# EasyEDA Pro project STM32F407VET6最小系统板.eprj, board STM32F407最小系统板_V01
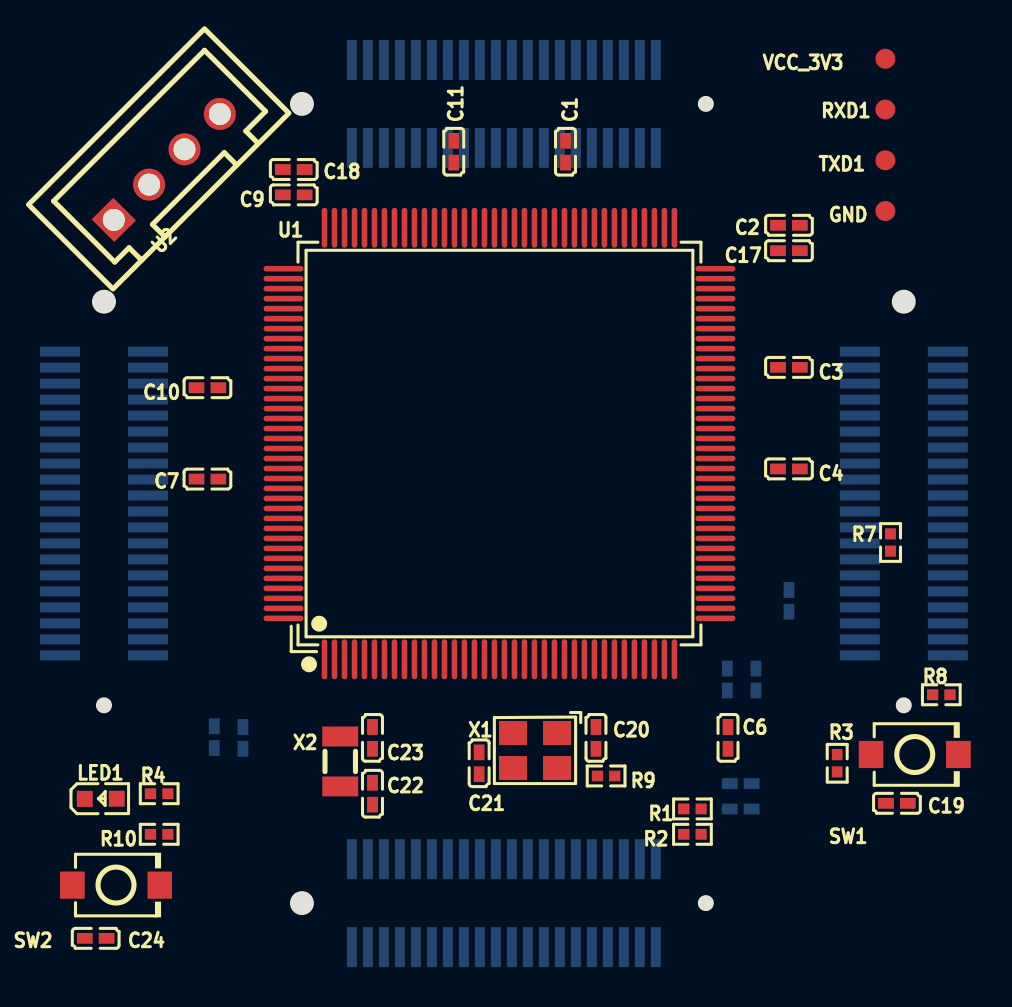
[diagram p4: board, top side]
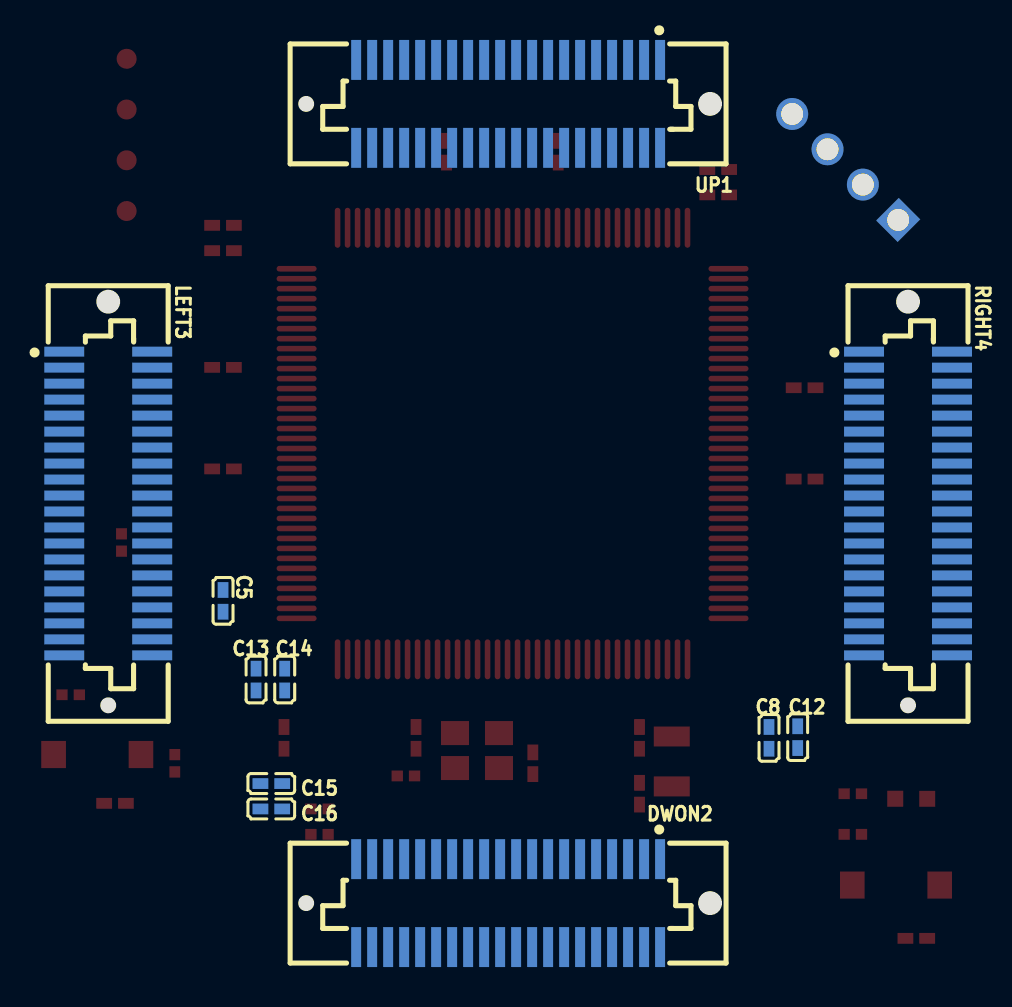
[diagram p5: board, bottom side, seen from below]

Outline 41.19 x 41.19 mm; copper layers: Top Layer, Bottom Layer. Coordinates in mm from the lower left corner of the outline.
Stack: Top Layer 0.035mm / Dielectric1 1.51mm FR4 er 4.5 / Bottom Layer 0.035mm

## Design rules (mm)
template: JLCPCB Capability(Two Layers Board)
spacing copperThickness1oz (default): track to track 0.102, other pairs 0.152 to 0.3
spacing copperThickness2oz: track to track 0.203, other pairs 0.152 to 0.3
track width copperThickness1oz (default): min 0.127, default 0.254, max 2.54
track width copperThickness2oz: min 0.203, default 0.254, max 2.54
differential pair differentialPair (default): width min 0.127, default 0.254, max 2.54; gap min 0.152, default 0.152
via viaSize (default): diameter min 0.5, default 0.61, max 10; hole min 0.3, default 0.305, max 6.3

## Placement (name value [footprint] x y rotation side)
C1  100nF  [C0402]  23.68 38.2 270 top
C2  100nF  [C0402]  34.85 34.52 180 top
C3  100nF  [C0402]  34.85 27.41 180 top
C4  100nF  [C0402]  34.85 22.33 180 top
C5  100nF  [C0402]  34.85 15.72 90 bottom
C6  100nF  [C0402]  31.8 8.86 90 top
C7  100nF  [C0402]  5.77 21.82 0 top
C8  100nF  [C0402]  7.55 8.86 90 bottom
C9  100nF  [C0402]  10.09 36.04 0 top
C10  100nF  [C0402]  5.77 26.39 0 top
C11  100nF  [C0402]  18.09 38.2 270 top
C12  4.7uF  [C0402]  6.11 8.9 90 bottom
C13  1uF  [C0402]  33.2 11.78 270 bottom
C14  100nF  [C0402]  31.77 11.78 270 bottom
C15  1uF  [C0402]  32.44 6.58 0 bottom
C16  100nF  [C0402]  32.44 5.31 0 bottom
C17  2.2uF  [C0402]  34.85 33.25 180 top
C18  2.2uF  [C0402]  10.09 37.31 0 top
C19  100nF  [C0402]  40.25 5.59 0 top
C20  12pF  [C0402]  25.2 8.86 90 top
C21  12pF  [C0402]  19.36 7.59 90 top
C22  12pF  [C0402]  14.02 6.07 90 top
C23  12pF  [C0402]  14.02 8.86 270 top
C24  100nF  [C0402]  0.18 -1.17 0 top
DWON2  X0802FVS-40AS-LPV01  [CONN-SMD_40P-P0.80_XKB_X0802FVS-40ADS-LPV01]  20.59 0.59 0 bottom
GND  -  [test-point-0.5mm]  39.67 35.23 0 top
LED1  XL-1608SURC-06  [LED0603-RD_RED]  0.43 5.82 0 top
LEFT3  X0802FVS-40AS-LPV01  [CONN-SMD_40P-P0.80_XKB_X0802FVS-40ADS-LPV01]  40.59 20.59 270 bottom
R1  0Ω  [R0402]  30.03 5.31 0 top
R2  0Ω  [R0402]  30.03 4.04 0 top
R3  10kΩ  [R0402]  37.26 7.59 90 top
R4  10kΩ  [R0402]  3.36 6.07 180 top
R7  10kΩ  [R0402]  39.93 18.64 270 top
R8  10kΩ  [R0402]  42.47 11.02 180 top
R9  1MΩ  [R0402]  25.71 6.96 0 top
R10  10kΩ  [R0402]  3.36 4.04 0 top
RIGHT4  X0802FVS-40AS-LPV01  [CONN-SMD_40P-P0.80_XKB_X0802FVS-40ADS-LPV01]  0.59 20.59 270 bottom
RXD1  -  [test-point-0.5mm]  39.67 40.31 0 top
SW1  TS-1088R-02026  [SW-SMD_L3.9-W3.0-P4.45]  41.14 8.03 0 top
SW2  TS-1088R-02026  [SW-SMD_L3.9-W3.0-P4.45]  1.2 1.5 0 top
TXD1  -  [test-point-0.5mm]  39.67 37.77 0 top
U1  STM32F407ZET6  [LQFP-144_L20.0-W20.0-P0.50-LS22.0-BL]  20.37 23.6 0 top
U2  ZX-XH2.54-4PZZ  [CONN-TH_4P-P2.50_4PIN]  3.74 37.44 45 top
UP1  X0802FVS-40AS-LPV01  [CONN-SMD_40P-P0.80_XKB_X0802FVS-40ADS-LPV01]  20.59 40.59 0 bottom
VCC_3V3  -  [test-point-0.5mm]  39.67 42.85 0 top
X1  8MHz  [OSC-SMD_4P-L3.2-W2.5-BL]  22.15 8.23 180 top
X2  32.768kHz  [FC-135R_L3.2-W1.5]  12.41 7.68 270 top

## Footprints (pads in the part's own frame, mm; a bottom-side part is the same pattern mirrored in y, then rotated)
C0402
  rect 0.79x0.54 smd: 1(-0.545,0) 2(0.545,0)
CONN-SMD_40P-P0.80_XKB_X0802FVS-40ADS-LPV01
  rect 0.5x2 smd: 1(-7.6,-2.2) 2(-7.6,2.2) 3(-6.8,-2.2) 4(-6.8,2.2) 5(-6,-2.2) 6(-6,2.2) 7(-5.2,-2.2) 8(-5.2,2.2) 9(-4.4,-2.2) 10(-4.4,2.2) 11(-3.6,-2.2) 12(-3.6,2.2) 13(-2.8,-2.2) 14(-2.8,2.2) 15(-2,-2.2) 16(-2,2.2) 17(-1.2,-2.2) 18(-1.2,2.2) 19(-0.4,-2.2) 20(-0.4,2.2) 21(0.4,-2.2) 22(0.4,2.2) 23(1.2,-2.2) 24(1.2,2.2) 25(2,-2.2) 26(2,2.2) 27(2.8,-2.2) 28(2.8,2.2) 29(3.6,-2.2) 30(3.6,2.2) 31(4.4,-2.2) 32(4.4,2.2) 33(5.2,-2.2) 34(5.2,2.2) 35(6,-2.2) 36(6,2.2) 37(6.8,-2.2) 38(6.8,2.2) 39(7.6,-2.2) 40(7.6,2.2)
CONN-TH_4P-P2.50_4PIN
  rect 1.524x1.6 hole 1.1: 1(-3.75,0)
  round 1.6 hole 1.1: 2(-1.25,0) 3(1.25,0) 4(3.75,0)
FC-135R_L3.2-W1.5
  rect 1x1.8 smd: 1(-1.25,0) 2(1.25,0)
LED0603-RD_RED
  rect 0.8x0.8 smd: 1(-0.799,-0.004) 2(0.799,0.004)
LQFP-144_L20.0-W20.0-P0.50-LS22.0-BL
  oval 0.28x2 smd: 1(-8.75,-10.8) 2(-8.25,-10.8) 3(-7.75,-10.8) 4(-7.25,-10.8) 5(-6.75,-10.8) 6(-6.25,-10.8) 7(-5.75,-10.8) 8(-5.25,-10.8) 9(-4.75,-10.8) 10(-4.25,-10.8) 11(-3.75,-10.8) 12(-3.25,-10.8) 13(-2.75,-10.8) 14(-2.25,-10.8) 15(-1.75,-10.8) 16(-1.25,-10.8) 17(-0.75,-10.8) 18(-0.25,-10.8) 19(0.25,-10.8) 20(0.75,-10.8) 21(1.25,-10.8) 22(1.75,-10.8) 23(2.25,-10.8) 24(2.75,-10.8) 25(3.25,-10.8) 26(3.75,-10.8) 27(4.25,-10.8) 28(4.75,-10.8) 29(5.25,-10.8) 30(5.75,-10.8) 31(6.25,-10.8) 32(6.75,-10.8) 33(7.25,-10.8) 34(7.75,-10.8) 35(8.25,-10.8) 36(8.75,-10.8) 73(8.75,10.8) 74(8.25,10.8) 75(7.75,10.8) 76(7.25,10.8) 77(6.75,10.8) 78(6.25,10.8) 79(5.75,10.8) 80(5.25,10.8) 81(4.75,10.8) 82(4.25,10.8) 83(3.75,10.8) 84(3.25,10.8) 85(2.75,10.8) 86(2.25,10.8) 87(1.75,10.8) 88(1.25,10.8) 89(0.75,10.8) 90(0.25,10.8) 91(-0.25,10.8) 92(-0.75,10.8) 93(-1.25,10.8) 94(-1.75,10.8) 95(-2.25,10.8) 96(-2.75,10.8) 97(-3.25,10.8) 98(-3.75,10.8) 99(-4.25,10.8) 100(-4.75,10.8) 101(-5.25,10.8) 102(-5.75,10.8) 103(-6.25,10.8) 104(-6.75,10.8) 105(-7.25,10.8) 106(-7.75,10.8) 107(-8.25,10.8) 108(-8.75,10.8)
  oval 2x0.28 smd: 37(10.8,-8.75) 38(10.8,-8.25) 39(10.8,-7.75) 40(10.8,-7.25) 41(10.8,-6.75) 42(10.8,-6.25) 43(10.8,-5.75) 44(10.8,-5.25) 45(10.8,-4.75) 46(10.8,-4.25) 47(10.8,-3.75) 48(10.8,-3.25) 49(10.8,-2.75) 50(10.8,-2.25) 51(10.8,-1.75) 52(10.8,-1.25) 53(10.8,-0.75) 54(10.8,-0.25) 55(10.8,0.25) 56(10.8,0.75) 57(10.8,1.25) 58(10.8,1.75) 59(10.8,2.25) 60(10.8,2.75) 61(10.8,3.25) 62(10.8,3.75) 63(10.8,4.25) 64(10.8,4.75) 65(10.8,5.25) 66(10.8,5.75) 67(10.8,6.25) 68(10.8,6.75) 69(10.8,7.25) 70(10.8,7.75) 71(10.8,8.25) 72(10.8,8.75) 109(-10.8,8.75) 110(-10.8,8.25) 111(-10.8,7.75) 112(-10.8,7.25) 113(-10.8,6.75) 114(-10.8,6.25) 115(-10.8,5.75) 116(-10.8,5.25) 117(-10.8,4.75) 118(-10.8,4.25) 119(-10.8,3.75) 120(-10.8,3.25) 121(-10.8,2.75) 122(-10.8,2.25) 123(-10.8,1.75) 124(-10.8,1.25) 125(-10.8,0.75) 126(-10.8,0.25) 127(-10.8,-0.25) 128(-10.8,-0.75) 129(-10.8,-1.25) 130(-10.8,-1.75) 131(-10.8,-2.25) 132(-10.8,-2.75) 133(-10.8,-3.25) 134(-10.8,-3.75) 135(-10.8,-4.25) 136(-10.8,-4.75) 137(-10.8,-5.25) 138(-10.8,-5.75) 139(-10.8,-6.25) 140(-10.8,-6.75) 141(-10.8,-7.25) 142(-10.8,-7.75) 143(-10.8,-8.25) 144(-10.8,-8.75)
OSC-SMD_4P-L3.2-W2.5-BL
  rect 1.4x1.2 smd: 1(-1.1,-0.875) 2(1.1,-0.875) 3(1.1,0.875) 4(-1.1,0.875)
R0402
  rect 0.566x0.54 smd: 1(-0.433,0) 2(0.433,0)
SW-SMD_L3.9-W3.0-P4.45
  rect 1.23x1.36 smd: 1(-2.185,0) 2(2.185,0)
test-point-0.5mm
  round 1 smd: 1(0,0)

## Nets
As in the schematic.
